# EasyEDA Pro project BLDCv5.eprj, schematic Schematic3
Create Date: 2024-10-31; Page Name: P1; Project Name: BLDCv5; Schematic Name: Schematic3; Update Date: 2024-10-30; Company: EasyEDA.com; Drawn: EasyEDA; Page Size: A4; Part Number: JLCPCB-002; Reviewed: EasyEDA; Version: V0.1
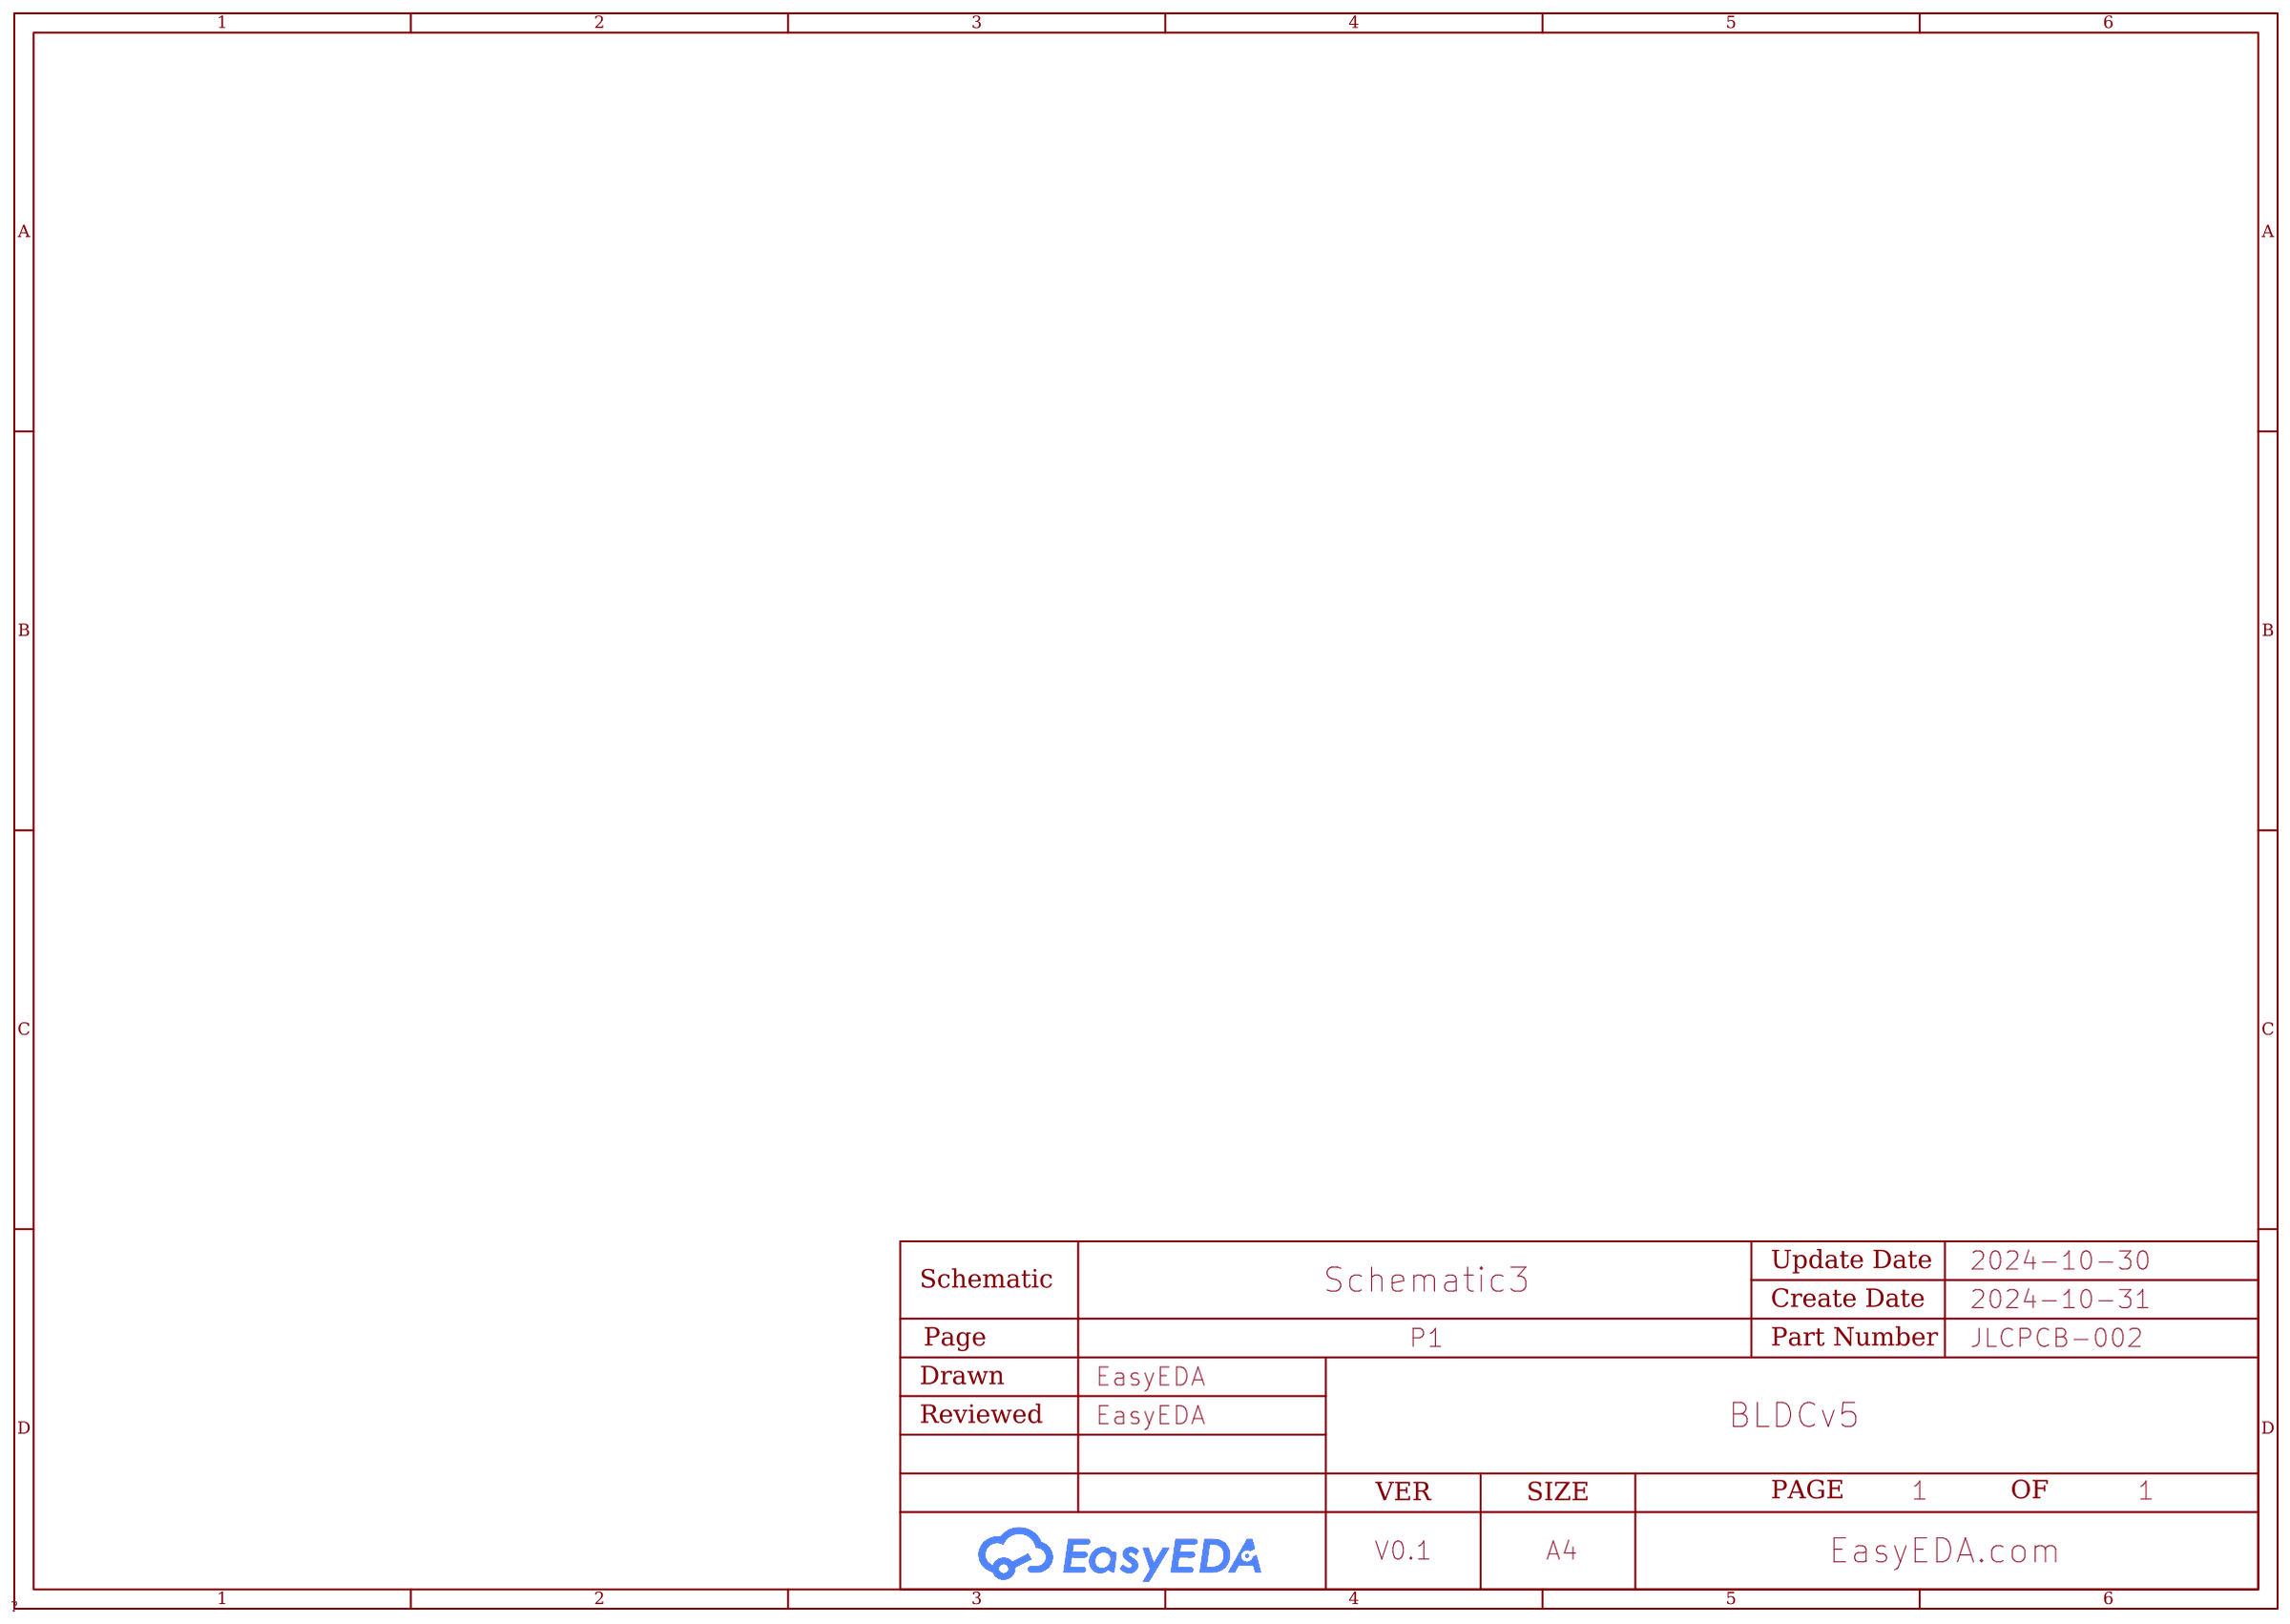
[diagram p3: schematic sheet]

## Parts
CBB1  -

## Nets

Not connected (* = marked no-connect by the designer): CBB1 (LOW_RAIL)
